# Altium schematic sheet big sheet.SchDoc: <Enter Sheet Title> (part 1 of 2) (continued)
## Nets
1V8_FTDI: C76.1 C117.1 C134.1 C135.1 U5.12(VCORE) U5.37(VCORE) U5.49(VREGOUT) U5.64(VCORE)
3V3_FTDI: C21.1 C22.1 C23.1 C24.1 C25.1 C26.1 C27.1 C28.1 C29.1 C30.1 C34.1 C35.1 C54.1 C55.1 C56.1 C64.2 C65.1 C69.1 C72.1 C75.1 C79.1 C80.1 C82.1 C83.1 C86.1 C87.1 C88.1 C89.1 C90.1 C91.1 C100.1 C110.1 C111.1 C112.1 C113.1 C114.1 C115.1 C121.1 C122.1 C125.1 C129.1 C136.1 C137.1 C138.1 C141.1 J1.2 J3.9(GREEN_A) J3.12(YELLOW_ANODE) J4.1(Vcc) J5.1 J7.2 L1.2 L3.1 L5.1 L6.1 L7.1 L9.1 LCD1.4(LEDA) LCD1.10(VCC) LCD1.11(VCC) P2.5 P2.7 P3.1 P3.17 P6.7 P9.1 P10.2 P11.2 PMOD0.6(VCC) PMOD0.12(VCC) PMOD1.6(VCC) PMOD1.12(VCC) R5.1 R6.1 R7.1 R20.1 R21.2 R45.1 R46.1 R54.1 R62.1 R64.1 R67.2 R71.2 R118.1 R119.1 R120.1 R121.1 R125.1 R126.1 R127.1 R128.1 R134.1 R160.2 R161.2 R162.2 R163.2 R164.2 R165.2 R166.2 R193.1 R199.1 R200.2 R201.2 R202.2 R203.1 R206.2 R207.2 R208.1 R209.1 R212.2 SD1.4(VDD) SJ1.1 SJ2.1 U3.8(VCC) U4.A17(VCCO_15) U4.B10(VCCO_16) U4.C13(VCCO_15) U4.D16(VCCO_15) U4.G15(VCCO_15) U4.H18(VCCO_15) U4.K4(VCCO_34) U4.K14(VCCO_15) U4.L17(VCCO_14) U4.N3(VCCO_34) U4.N13(VCCO_14) U4.P6(VCCO_34) U4.P8(CFGBVS_0) U4.P11(M2_0) U4.P12(M0_0) U4.P13(M1_0) U4.P16(VCCO_14) U4.R9(VCCO_0) U4.T2(VCCO_34) U4.T12(VCCO_14) U4.U5(VCCO_34) U4.U15(VCCO_14) U4.V8(VCCO_34) U4.V18(VCCO_14) U5.20(VCCIO) U5.31(VCCIO) U5.42(VCCIO) U5.50(VREGIN) U5.56(VCCIO) U7.15(VCC) U9.3(Vin) U11.1(IOVDD_1) U11.10(IOVDD_2) U11.22(IOVDD_3) U11.33(IOVDD_4) U11.42(IOVDD_5) U11.43(ADC_AVDD) U11.44(VREG_VIN) U11.48(USB_VDD) U11.49(IOVDD_6) U13.15(VREG_33) U13.16(VCC_5) U16.6(ORG) U16.8(VCC) U17.8(VCC) U18.8(VCC) U19.8(VCC) U22.5(VDD) U23.5(VDD) Y2.1(~{STBY}) Y2.4(VDD)  [also labelled VCCIO]
+1V85_XADC_VCC: C58.1 C59.1 C139.1 R37.1 U4.H10(VCCADC_0) U14.1(IN) U15.5(VOUT)
GND: C1.2 C2.2 C3.2 C5.2 C6.2 C7.2 C8.2 C9.2 C10.2 C11.2 C12.2 C13.2 C14.2 C15.2 C16.2 C17.2 C18.2 C19.2 C20.2 C21.2 C22.2 C23.2 C24.2 C25.2 C26.2 C27.2 C28.2 C29.2 C30.2 C31.2 C32.2 C33.2 C34.2 C35.2 C36.2 C37.2 C38.2 C39.2 C40.2 C41.2 C42.2 C43.2 C44.2 C45.2 C46.2 C47.2 C48.2 C50.2 C51.2 C52.2 C53.2 C54.2 C55.2 C56.2 C57.2 C58.2 C59.2 C62.2 C63.1 C64.1 C65.2 C66.2 C67.2 C68.2 C69.2 C70.2 C71.2 C72.2 C73.2 C74.2 C75.2 C76.2 C77.2 C78.2 C79.2 C80.2 C81.2 C82.2 C83.2 C84.2 C85.2 C86.2 C87.2 C88.2 C89.2 C90.2 C91.2 C92.2 C93.2 C94.2 C95.2 C96.2 C97.2 C99.2 C100.2 C101.2 C102.2 C108.2 C109.2 C110.2 C111.2 C112.2 C113.2 C114.2 C115.2 C116.2 C117.2 C118.2 C119.1 C120.2 C121.2 C122.2 C123.2 C124.2 C125.2 C126.2 C127.2 C128.2 C129.2 C130.2 C131.2 C132.2 C133.2 C134.2 C135.2 C136.2 C137.2 C138.2 C139.2 C141.2 C142.1 D3.K D4.K D5.K D6.K D7.K D8.K D9.K D10.K D11.K D12.K D13.K D14.K D15.K D16.K D17.K D18.K D19.K D20.K D22.K D23.K D24.K D25.K E1.A2 E2.A1 E3.A1 IC1.B3(VSS) IC1.C1(VSSQ_1) IC1.E5(VSSQ_2) J1.1 J2.A1-B12(GND) J2.B1-A12(GND) J3.8(CHS_GROUND) J4.3(GND) J4.5(GND) J4.9(GNDD) J5.4 J5.6 J5.8 J5.10 J5.12 J5.14 J5.16 J5.18 J5.20 J6.A1-B12(GND) J6.B1-A12(GND) J7.1 LCD1.2(GND) LCD1.5(GND) LCD1.13(GND) LED1.5(GND) LED2.5(GND) P2.2 P2.3 P3.6 P3.9 P3.14 P3.20 P3.25 P3.30 P3.34 P3.39 P4.7 P6.8 P7.8 P9.4 P10.6 P11.6 PMOD0.5(GND) PMOD0.11(GND) PMOD1.5(GND) PMOD1.11(GND) Q2.2(S) Q3.2(S) Q4.1(G) Q5.1(G) R1.2 R3.2 R4.2 R8.2 R11.2 R13.2 R14.2 R16.2 R17.1 R24.2 R25.2 R28.2 R33.2 R35.1 R36.1 R38.2 R39.2 R43.2 R76.1 R80.2 R81.1 R87.1 R88.2 R90.1 R94.1 R95.2 R96.1 R101.1 R102.2 R103.1 R108.1 R109.2 R110.1 R115.1 R116.2 R117.1 R129.2 R133.2 R135.2 R167.1 R195.1 R205.2 R213.1 SD1.6(VSS) SD1.10(SB) SD1.11(SHLD) SD1.12(SHLD) SD1.13(SHLD) SD1.14(SHLD) SW3.3(C) SW3.5(MNT_1) SW3.6(MNT_2) SW3.7(MNT_3) SW3.8(MNT_4) SW4.1 SW4.2 SW4.3 SW4.4 SW4.5 SW4.6 SW4.7 SW4.8 SW5.1(IN) SW6.7 SW6.8 SW7.3(C) SW7.5(MNT_1) SW7.6(MNT_2) SW7.7(MNT_3) SW7.8(MNT_4) SW8.5 SW8.MP1 SW8.MP2 SW8.MP3 SW8.MP4 SW9.3 SW9.4 SW9.5(Ground) U1.1(GND) U2.1(GND) U3.5(GND) U4.A2(GND) U4.A12(GND) U4.B5(GND) U4.B15(GND) U4.C8(GND) U4.C18(GND) U4.D1(GND) U4.D11(GND) U4.E4(GND) U4.E14(GND) U4.F7(GND) U4.F9(GND) U4.F11(GND) U4.F17(GND) U4.G8(GND) U4.G10(GND) U4.G12(GND) U4.H3(GND) U4.H7(GND) U4.H9(GNDADC_0) U4.H11(GND) U4.H13(GND) U4.J6(GND) U4.J8(GND) U4.J12(GND) U4.J16(GND) U4.K7(GND) U4.K11(GND) U4.L2(GND) U4.L8(GND) U4.L12(GND) U4.M5(GND) U4.M7(GND) U4.M9(GND) U4.M11(GND) U4.M15(GND) U4.N8(GND) U4.N10(GND) U4.N12(GND) U4.N18(GND) U4.P1(GND) U4.R4(GND) U4.R14(GND) U4.T7(GND) U4.T17(GND) U4.U10(GND) U4.V3(GND) U4.V13(GND) U5.1(GND) U5.5(GND) U5.10(AGND) U5.11(GND) U5.13(TEST) U5.15(GND) U5.25(GND) U5.35(GND) U5.47(GND) U5.51(GND) U5.65(GND) U6.4(DGND) U6.8(AGND) U6.13(AGND) U6.18(AGND) U6.22(DGND) U6.24(DGND) U6.29(DGND) U6.33(Paddle_Ground) U7.14(GND) U8.1(PGND) U8.2(PGND) U8.3(PGND) U8.5(GND) U8.17(PGND) U9.1(GND) U10.1(PGND) U10.2(PGND) U10.3(PGND) U10.5(GND) U10.17(PGND) U11.19(TESTEN) U11.57(GND) U12.25(VSS) U13.8(GND) U14.3(GND) U15.2(GND) U16.5(GND) U16.7(NC) U17.4(VSS) U17.9(EP) U18.4(VSS) U18.9(EP) U19.4(VSS) U19.9(EP) U20.11(VSS) U21.9(VINC-) U21.11(VSS) U21.13(VIND-) U22.2(GND) U23.2(GND) X1.2(GND) X1.4(GND) X2.2(GND) X2.4(GND) Y1.2 Y1.4 Y2.2(GND/Case) Y3.2 Y3.4  [also labelled XADC_AGND]
VCC1V8: C14.1 C15.1 C16.1 C17.1 C18.1 C19.1 C20.1 C31.1 C32.1 C53.1 C66.1 C67.1 C68.1 C123.1 C127.1 C131.1 C132.1 C133.1 IC1.B4(VCC) IC1.D1(VCCQ_1) IC1.E4(VCCQ_2) L8.1 R30.2 R32.2 R211.1 U4.A7(VCCO_35) U4.C3(VCCO_35) U4.D6(VCCO_35) U4.E8(VCCBATT_0) U4.F2(VCCO_35) U4.F12(VCCAUX) U4.G5(VCCO_35) U4.H12(VCCAUX) U4.J1(VCCO_35) U4.K12(VCCAUX) U4.M12(VCCAUX) U6.5(VDD_CO1.8) U6.23(VDD_D1.8) U6.25(VDD_IO) U6.30(VDD_IO) U9.2(Vout) U9.4(P) U13.9(VCC(I/O))
VCC_1V8A: C124.1 C128.1 L8.2 U6.9(VDD_A1.8)
VCCINT: C6.1 C7.1 C8.1 C9.1 C10.1 C11.1 C12.1 C13.1 C37.1 C38.1 L2.2 R9.1 U4.F8(VCCINT) U4.F10(VCCBRAM) U4.G7(VCCINT) U4.G9(VCCINT) U4.G11(VCCBRAM) U4.H8(VCCINT) U4.J7(VCCINT) U4.J11(VCCINT) U4.K8(VCCINT) U4.L7(VCCINT) U4.L11(VCCINT) U4.M8(VCCINT) U4.M10(VCCINT) U4.N7(VCCINT) U4.N9(VCCINT) U4.N11(VCCINT)
VCCOPAMP: C97.1 C99.1 C101.1 C102.1 R82.2 U20.4(VDD) U21.4(VDD) U21.10(VINC+) U21.12(VIND+)
VCCUSB3V3: C40.1 C41.1 C42.1 C43.1 C44.1 C45.1 C46.1 R15.1 R18.1 R72.2 R203.2 U2.2(Vout) U2.4(P) U12.1(VDD33) U12.9(VDD33) U12.18(VDD33)
232_RX: U4.N6(IO_L18N_T2_34) U7.9(ROUT)
232_TX: U4.P3(IO_L14N_T2_SRCC_34) U7.11(DIN)
485_DE: U3.3(DE) U4.M4(IO_L16P_T2_34)
485_DI: U3.4(DI) U4.M6(IO_L18P_T2_34)
485_REn: U3.2(~{RE}) U4.N4(IO_L16N_T2_34)
485_RO: U3.1(RO) U4.R2(IO_L15N_T2_DQS_34)
AH_AN0: P5.6 P6.1 R75.1 R77.1
AH_AN1: P5.5 R83.1 R84.1
AH_AN2: P5.4 R89.1 R91.1
AH_AN3: P5.3 R97.1 R98.1
AH_AN4: P5.2 R104.1 R105.1
AH_AN5: P5.1 R111.1 R112.1
AH_TMPIO0: P1.1 R188.1B
AH_TMPIO1: P1.2 R188.2B
AH_TMPIO2: P1.3 R188.3B
AH_TMPIO3: P1.4 R188.4B
AH_TMPIO4: P1.5 R189.1B
AH_TMPIO5: P1.6 R189.2B
AH_TMPIO6: P1.7 R189.3B
AH_TMPIO7: P1.8 R189.4B
AH_TMPIO8: P4.1 R190.1B
AH_TMPIO9: P4.2 R190.2B
AH_TMPIO10: P4.3 R190.3B
AH_TMPIO11: P4.4 R190.4B
AH_TMPIO12: P4.5 R191.1B
AH_TMPIO13: P4.6 R191.2B
AH_TMPIO14: P11.1 R191.3B
AH_TMPIO15: P11.3 R191.4B
AH_TMPIO16: P11.5 R168.2
AH_TMPIO17: P11.4 R169.2
ANALOG0_DIGITAL: R77.2 U4.G13(IO_0_15) U22.4(IO3)
ANALOG0_N: C98.2 R81.2 U4.C5(IO_L1N_T0_AD4N_35)
ANALOG0_P: C98.1 R79.2 U4.C6(IO_L1P_T0_AD4P_35)
ANALOG1_DIGITAL: R83.2 U4.D14(IO_L1P_T0_AD0P_15) U22.6(IO4)
ANALOG1_N: C103.2 R90.2 U4.B6(IO_L2N_T0_AD12N_35)
ANALOG1_P: C103.1 R86.2 U4.B7(IO_L2P_T0_AD12P_35)
ANALOG2_DIGITAL: R89.2 U4.C14(IO_L1N_T0_AD0N_15) U22.3(IO2)
ANALOG2_N: C104.2 R96.2 U4.A5(IO_L3N_T0_DQS_AD5N_35)
ANALOG2_P: C104.1 R93.2 U4.A6(IO_L3P_T0_DQS_AD5P_35)
ANALOG3_DIGITAL: R97.2 U4.C9(IO_L11P_T1_SRCC_16) U22.1(IO1)
ANALOG3_N: C105.2 R103.2 U4.E5(IO_L5N_T0_AD13N_35)
ANALOG3_P: C105.1 R100.2 U4.E6(IO_L5P_T0_AD13P_35)
ANALOG4_DIGITAL: R104.2 U4.B9(IO_L11N_T1_SRCC_16) U23.4(IO3)
ANALOG4_N: C106.2 R110.2 U4.B4(IO_L7N_T1_AD6N_35)
ANALOG4_P: C106.1 R107.2 U4.C4(IO_L7P_T1_AD6P_35)
ANALOG5_DIGITAL: R111.2 U4.B8(IO_L12P_T1_MRCC_16) U23.6(IO4)
ANALOG5_N: C107.2 R117.2 U4.A3(IO_L8N_T1_AD14N_35)
ANALOG5_P: C107.1 R114.2 U4.A4(IO_L8P_T1_AD14P_35)
APPSPI_CLK: R52.2 U4.A8(IO_L12N_T1_MRCC_16)
APPSPI_CS: R50.2 U4.D10(IO_L19N_T3_VREF_16)
APPSPI_D0: R47.1 U4.C11(IO_L13P_T2_MRCC_16)
APPSPI_D1: R48.1 U4.C10(IO_L13N_T2_MRCC_16)
APPSPI_D2: R49.1 U4.A10(IO_L14P_T2_SRCC_16)
APPSPI_D3: R51.1 U4.A9(IO_L14N_T2_SRCC_16)
CHA_TCK: SW1.3 U5.16(ADBUS0)
CHA_TDI: SW1.1 U5.17(ADBUS1)
CHA_TDO: SW1.2 U5.18(ADBUS2)
CHA_TMS: SW1.4 U5.19(ADBUS3)
CHB_GPIOL2: SW2.7 U5.33(BDBUS6)
CHB_GPIOL3: SW2.8 U5.34(BDBUS7)
CHB_nRST: SW2.5 U5.30(BDBUS4)
CHB_nSRST: SW2.6 U5.32(BDBUS5)
CHB_TCK: SW2.1 U5.26(BDBUS0)
CHB_TDI: SW2.2 U5.27(BDBUS1)
CHB_TDO: SW2.3 U5.28(BDBUS2)
CHB_TMS: SW2.4 U5.29(BDBUS3)
CHC_RXD: P12.3 U5.39(CDBUS1)
CHC_TXD: P12.1 U5.38(CDBUS0)
CHD_RXD: P12.7 U5.52(DDBUS1)
CHD_TXD: P12.5 U5.48(DDBUS0)
CHERIERR0: R139.1 SW2.10 U4.K6(IO_0_34)
CHERIERR1: R141.1 SW2.9 U4.L1(IO_L1P_T0_34)
CHERIERR2: R143.1 U4.M1(IO_L1N_T0_34)
CHERIERR3: R145.1 U4.K3(IO_L2P_T0_34)
CHERIERR4: R146.1 U4.L3(IO_L2N_T0_34)
CHERIERR5: R148.1 U4.N2(IO_L3P_T0_DQS_34)
CHERIERR6: R150.1 U4.N1(IO_L3N_T0_DQS_34)
CHERIERR7: R152.1 U4.M3(IO_L4P_T0_34)
CHERIERR8: R154.1 U4.M2(IO_L4N_T0_34)
ETHAVCC: C120.1 C126.1 C130.1 J3.4(CT) J3.5(CT) L9.2 U6.16(VDD_A3.3)
ETHCLK: R123.2 R124.1
ETHMAC_CIPO: U4.D4(IO_L11N_T1_SRCC_35) U6.27(SO)
ETHMAC_COPI: U4.D5(IO_L11P_T1_SRCC_35) U6.31(SI)
ETHMAC_CS: U4.H5(IO_L24N_T3_35) U6.26(CSN)
ETHMAC_INTR: R211.2 U4.H6(IO_L24P_T3_35) U6.3(~{INTR})
ETHMAC_LED0: R136.1 U6.1(LED0)
ETHMAC_LED1: R137.1 U6.32(LED1)
ETHMAC_RST: U4.J5(IO_25_35) U6.19(~{RST})
ETHMAC_RX_N: J3.6(RD-) R204.2 U6.12(RXM)
ETHMAC_RX_P: J3.3(RD+) R198.2 U6.11(RXP)
ETHMAC_SCLK: U4.E3(IO_L12P_T1_MRCC_35) U6.28(SCLK)
ETHMAC_TX_N: J3.2(TD-) R197.2 U6.15(TXM)
ETHMAC_TX_P: J3.1(TD+) R196.2 U6.14(TXP)
FPGA_CCLK: R65.1 U4.E9(CCLK_0)
FPGA_DONE: R134.2 U4.P10(DONE_0) U11.9(GPIO7)
FPGA_INITB: R5.2 U4.P7(INIT_B_0) U11.11(GPIO8)
FPGA_PGMB: R6.2 U4.P9(PROGRAM_B_0) U11.12(GPIO9)
FPGA_TCK: P10.3 R119.2 SW1.6 U4.E10(TCK_0)
FPGA_TDI: P10.1 R118.2 SW1.8 U4.E11(TDI_0)
FPGA_TDO: P10.4 R120.2 SW1.7 U4.E13(TDO_0)
FPGA_TMS: P10.5 R121.2 SW1.5 U4.E12(TMS_0)
FPGAIO_TURBO: SW6.2 U4.T4(IO_L12N_T1_MRCC_34)
FTDI_N: U5.7(DM) U12.2(USBDM_DN1/PRT_DIS_M1)
FTDI_NRST: R42.2 R73.2
FTDI_P: U5.8(DP) U12.3(USBDP_DN1/PRT_DIS_P1)
HYPERRAM_CK_N: IC1.B1(CK#) U4.G2(IO_L15N_T2_DQS_35)
HYPERRAM_CK_P: IC1.B2(CK) U4.H2(IO_L15P_T2_DQS_35)
HYPERRAM_CS: IC1.A3(CS#) U4.J2(IO_L22N_T3_35)
HYPERRAM_DQ0: IC1.D3(DQ0) U4.B1(IO_L9P_T1_DQS_AD7P_35)
HYPERRAM_DQ1: IC1.D2(DQ1) U4.E2(IO_L14P_T2_SRCC_35)
HYPERRAM_DQ2: IC1.C4(DQ2) U4.H1(IO_L17P_T2_35)
HYPERRAM_DQ3: IC1.D4(DQ3) U4.A1(IO_L9N_T1_DQS_AD7N_35)
HYPERRAM_DQ4: IC1.D5(DQ4) U4.E1(IO_L18N_T2_35)
HYPERRAM_DQ5: IC1.E3(DQ5) U4.B2(IO_L10N_T1_AD15N_35)
HYPERRAM_DQ6: IC1.E2(DQ6) U4.C1(IO_L16N_T2_35)
HYPERRAM_DQ7: IC1.E1(DQ7) U4.D2(IO_L14N_T2_SRCC_35)
HYPERRAM_nRST: IC1.A4(RESET#) U4.C2(IO_L16P_T2_35)
HYPERRAM_RWDS: IC1.C3(RWDS) U4.F1(IO_L18P_T2_35)
LCD_BACKLIGHT: Q2.1(G) R133.1 U4.N5(IO_L13P_T2_MRCC_34)
LCD_CLK: LCD1.9(SCL) U4.R5(IO_L19N_T3_VREF_34)
LCD_COPI: LCD1.8(SDA) U4.R3(IO_L11P_T1_SRCC_34)
LCD_CS: LCD1.12(CS) U4.P5(IO_L13N_T2_MRCC_34)
LCD_DC: LCD1.7(RS) U4.U4(IO_L8P_T1_34)
LCD_RST: LCD1.6(RESET) U4.R6(IO_L19P_T3_34)
LED_BOOTOK: R158.1 U4.L5(IO_L6N_T0_VREF_34)
LED_CHERI: R155.1 U4.L4(IO_L5N_T0_34)
LED_HALTED: R159.1 U4.L6(IO_L6P_T0_34)
LED_LEGACY: R157.1 U4.K5(IO_L5P_T0_34)
MAINCLK: R122.2 U4.P15(IO_L13P_T2_MRCC_14)
MB0: P6.2 R178.1B
MB1: P6.3 R178.2B
MB2: P6.4 R178.3B
MB3: P6.5 R178.4B
MB4: P6.6 R180.1B
MB5: P7.6 R180.2B R209.2
MB6: P7.5 R180.3B R208.2
MB7: P7.4 R180.4B
MB8: P7.3 R184.1B
MB9: P7.2 R184.2B
MB10: P7.1 R184.3B
MICROSD_CLK: R162.1 SD1.5(CLK) U4.U6(IO_L22N_T3_34)
MICROSD_CMD: R163.1 SD1.3(CMD) U4.R8(IO_L24P_T3_34)
MICROSD_DAT0: R161.1 SD1.7(DAT0) U4.V4(IO_L10N_T1_34)
MICROSD_DAT1: R160.1 SD1.8(DAT1) U4.R7(IO_L23P_T3_34)
MICROSD_DAT2: R165.1 SD1.1(DAT2) U4.V5(IO_L10P_T1_34)
MICROSD_DAT3: R164.1 SD1.2(CD/DAT3) U4.T8(IO_L24N_T3_34)
MICROSD_DET: R166.1 SD1.9(SA) U4.B3(IO_L10P_T1_AD15P_35)
NAVSW_0: SW8.1 U4.F5(IO_0_35)
NAVSW_1: SW8.4 U4.D8(IO_L4P_T0_35)
NAVSW_2: SW8.2 U4.C7(IO_L4N_T0_35)
NAVSW_3: SW8.3 U4.E7(IO_L6P_T0_35)
NAVSW_4: SW8.6 U4.D7(IO_L6N_T0_VREF_35)
NRST: J4.10(RST) J5.15 P2.6 R20.2 SW2.12 SW5.2(IN) U4.T5(IO_L12P_T1_MRCC_34) U11.28(GPIO17)
PMOD0_1: PMOD0.1(IO1) R174.1B
PMOD0_2: PMOD0.2(IO2) R174.2B
PMOD0_3: PMOD0.3(IO3) R174.3B
PMOD0_4: PMOD0.4(IO4) R174.4B
PMOD0_5: PMOD0.7(IO5) R176.1B
PMOD0_6: PMOD0.8(IO6) R176.2B
PMOD0_7: PMOD0.9(IO7) R176.3B
PMOD0_8: PMOD0.10(IO8) R176.4B
PMOD1_1: PMOD1.1(IO1) R172.1B
PMOD1_2: PMOD1.2(IO2) R172.2B
PMOD1_3: PMOD1.3(IO3) R172.3B
PMOD1_4: PMOD1.4(IO4) R172.4B
PMOD1_5: PMOD1.7(IO5) R173.1B
PMOD1_6: PMOD1.8(IO6) R173.2B
PMOD1_7: PMOD1.9(IO7) R173.3B
PMOD1_8: PMOD1.10(IO8) R173.4B
PMODC_1: P8.1 R194.4B
PMODC_2: P8.2 R186.2
PMODC_3: P8.3 R187.2
PMODC_4: P8.4 R194.1B
PMODC_5: P8.5 R194.2B
PMODC_6: P8.6 R194.3B
PWRIN_5V: C2.1 C3.1 C5.1 C33.1 C36.1 C39.1 P2.1 P3.2 P3.4 P7.7 Q4.2(S) Q5.2(S) R19.2 R41.2 SJ1.3 U2.3(Vin) U8.9(VDD) U8.10(PVDD) U8.11(PVDD) U8.12(PVDD) U10.9(VDD) U10.10(PVDD) U10.11(PVDD) U10.12(PVDD)
QSPI_CS: R50.1 R57.1 U17.1(~{S})
QSPI_D0: R47.2 R60.1 U17.5(DQ0)
QSPI_D1: R48.2 R55.1 U17.2(DQ1)
QSPI_D2: R46.2 R49.2 R61.1 U17.3(~{W}/DQ2)
QSPI_D3: R45.2 R51.2 R63.1 U17.7(DQ3/~{HOLD})
QSPI_SCLK: R52.1 R59.1 U17.6(C)
RGBLED0: Q3.1(G) R193.2 R205.1 R210.1 U4.D9(IO_L6N_T0_VREF_16)
RP2040_CLK: R70.1 U4.T14(IO_L14P_T2_SRCC_14)
RP2040_LED0: D26.K U11.38(GPIO26/ADC0)
RP2040_LED1: D27.K U11.37(GPIO25)
RP2040_LED2: D28.K U11.36(GPIO24)
RP2040_LED3: R156.1 U11.29(GPIO18)
RP2040_N: R58.1 U12.4(USBDM_DN2/PRT_DIS_M2)
RP2040_NRST: R71.1 R74.2 U11.26(RUN)
RP2040_P: R56.1 U12.5(USBDP_DN2/PRT_DIS_P2)
RP2040_PREQ: R171.2 U11.8(GPIO6)
RP2040_RGBLED0: R210.2 U11.18(GPIO15)
RP2040_RX: R68.1 U4.M17(IO_L10N_T1_D15_14)
RP2040_SPARE: R69.1 U4.P4(IO_L14P_T2_SRCC_34)
RP2040_SW0: SW3.1 U11.41(GPIO29/ADC3)
RP2040_SW1: SW3.2 U11.40(GPIO28/ADC2)
RP2040_SW2: SW3.4 U11.39(GPIO27/ADC1)
RP2040_TX: R66.1 U4.K18(IO_L1N_T0_D01_DIN_14)
RP_N: R58.2 U11.46(USB_DM)
RP_P: R56.2 U11.47(USB_DP)
RPH_G0: P3.27 R179.4B
RPH_G1: P3.28 R183.4B
RPH_G2_SDA: P3.3 R175.3B R206.1
RPH_G3_SCL: P3.5 R175.4B R207.1
RPH_G4: P3.7 R177.1B
RPH_G5: P3.29 R181.1B
RPH_G6: P3.31 R181.2B
RPH_G7_SPI0_CE1: P3.26 R183.3B
RPH_G8_SPI0_CE0: P3.24 R183.2B
RPH_G9_SPI0_CIPO: P3.21 R179.2B
RPH_G10_SPI0_COPI: P3.19 R179.1B
RPH_G11_SPI0_SCLK: P3.23 R179.3B
RPH_G12: P3.32 R185.1B
RPH_G13: P3.33 R181.3B
RPH_G16_CE2: P3.36 R185.2B
RPH_G17_SPI1_CE1: P3.11 R177.2B
RPH_G18_SPI1_CE0: P3.12 R182.2B
RPH_G19_SPI1_CIPO: P3.35 R181.4B
RPH_G20_SPI1_COPI: P3.38 R185.3B
RPH_G21_SPI1_SCLK: P3.40 R185.4B
RPH_G22: P3.15 R177.4B
RPH_G23: P3.16 R182.3B
RPH_G24: P3.18 R182.4B
RPH_G25: P3.22 R183.1B R212.1 R213.2
RPH_G26: P3.37 R182.1B
RPH_G27: P3.13 R177.3B
RPH_RXD0: P3.10 R175.1B
RPH_TXD0: P3.8 R175.2B
SCL0: J1.4 P4.10 R126.2 R170.2B
SCL1: J7.4 R128.2 R170.4B
SDA0: J1.3 P4.9 R125.2 R170.1B
SDA1: J7.3 R127.2 R170.3B
SELSW0: SW7.1 U4.D3(IO_L12N_T1_MRCC_35)
SELSW1: SW7.2 U4.F4(IO_L13P_T2_MRCC_35)
SELSW2: SW7.4 U4.F3(IO_L13N_T2_MRCC_35)
SER0_RX: P12.2 U4.D18(IO_L21N_T3_DQS_A18_15)
SER0_TX: P12.4 U4.C17(IO_L20N_T3_A19_15)
SER1_RX: P12.6 U4.G18(IO_L22P_T3_A17_15)
SER1_TX: P12.8 U4.E18(IO_L21P_T3_DQS_15)
USB_N: J2.A7(Dn1) J2.B7(Dn2) U1.2(IO1) U12.19(USBDM_UP)
USB_nSUSPEND: R14.1 SW6.6 U12.17(SUSP_IND/LOCAL_PWR/(NON_REM0))
USB_P: J2.A6(Dp1) J2.B6(Dp2) U1.3(IO2) U12.20(USBDP_UP)
USB_VBUS: C1.1 J2.A4-B9(VBUS) J2.B4-A9(VBUS) Q1.2(S) R2.1 R12.2 R13.1 U1.4(VCC)
USBC_3_D_N: J6.A7(Dn1) J6.B7(Dn2) R29.1 R34.1 R35.2
USBC_3_D_P: J6.A6(Dp1) J6.B6(Dp2) R27.1 R31.1 R36.2
USBC_F_D_N: R29.2 U13.11(D-)
USBC_F_D_P: R27.2 U13.12(D+)
USR_JTAG_TCK: J4.4(TCK) J5.9 J5.11 SW2.16 U4.E15(IO_L11P_T1_SRCC_15)
USR_JTAG_TDI: J4.8(TDI) J5.5 SW2.15 U4.G17(IO_L18N_T2_A23_15)
USR_JTAG_TDO: J4.6(TDO) J5.13 SW2.14 U4.J14(IO_L19P_T3_A22_15)
USR_JTAG_TMS: J4.2(TMS) J5.7 SW2.13 U4.H15(IO_L19N_T3_A21_VREF_15)
USR_JTAG_TRST: J5.3 SW2.11 U4.C16(IO_L20P_T3_A20_15)
USRLED0: R138.1 U4.B13(IO_L2P_T0_AD8P_15)
USRLED1: R140.1 U4.B14(IO_L2N_T0_AD8N_15)
USRLED2: R142.1 U4.C12(IO_L3P_T0_DQS_AD1P_15)
USRLED3: R144.1 U4.B12(IO_L3N_T0_DQS_AD1N_15)
USRLED4: R147.1 U4.B11(IO_L4P_T0_15)
USRLED5: R149.1 U4.A11(IO_L4N_T0_15)
USRLED6: R151.1 U4.F13(IO_L5P_T0_AD9P_15)
USRLED7: R153.1 U4.F14(IO_L5N_T0_AD9N_15)
USRSW0: SW4.16 U4.D12(IO_L6P_T0_15)
USRSW1: SW4.15 U4.D13(IO_L6N_T0_VREF_15)
USRSW2: SW4.14 U4.B16(IO_L7P_T1_AD2P_15)
USRSW3: SW4.13 U4.B17(IO_L7N_T1_AD2N_15)
USRSW4: SW4.12 U4.A15(IO_L8P_T1_AD10P_15)
USRSW5: SW4.11 U4.A16(IO_L8N_T1_AD10N_15)
USRSW6: SW4.10 U4.A13(IO_L9P_T1_DQS_AD3P_15)
USRSW7: SW4.9 U4.A14(IO_L9N_T1_DQS_AD3N_15)
USRUSB_OE: R30.1 U4.J3(IO_L22P_T3_35) U13.3(~{OE})
USRUSB_RCV: U4.J4(IO_L21P_T3_DQS_35) U13.4(RCV)
USRUSB_SOFTCN: U4.H4(IO_L21N_T3_DQS_35) U13.2(SOFTCON)
USRUSB_SPD: U4.G1(IO_L17N_T2_35) U13.10(SPEED)
USRUSB_SUS: R32.1 U4.K2(IO_L23P_T3_35) U13.7(SUSPND)
USRUSB_V_N: U4.F6(IO_L19N_T3_VREF_35) U13.6(VM)
USRUSB_V_P: U4.G6(IO_L19P_T3_35) U13.5(VP)
USRUSB_VBUSDETECT: R23.2 R25.1 U4.K1(IO_L23N_T3_35)
USRUSB_VMO: U4.G3(IO_L20N_T3_35) U13.14(VMO)
USRUSB_VPO: U4.G4(IO_L20P_T3_35) U13.13(VPO)
XADC_VREF_N: C60.2 C140.2 R195.2 U4.J9(VREFN_0)
XADC_VREF_P: C60.1 C140.1 U4.K10(VREFP_0) U14.2(OUT)
NetC4_1: C4.1 Q1.3(D) Q5.3(D)
NetC4_2: C4.2 Q1.1(G) R2.2 R3.1
NetC47_1: C47.1 U12.10(CRFILT)
NetC48_1: C48.1 U12.23(PLLFILT)
NetC49_1: C49.1 U7.5(C2+)
NetC49_2: C49.2 U7.6(C2-)
NetC50_1: C50.1 C51.1 J6.A4-B9(VBUS) J6.B4-A9(VBUS) R22.1 R23.1 R26.1 R41.1
NetC52_1: C52.1 J6.1(MNT_1) J6.2(MNT_2) J6.3(MNT_3) J6.4(MNT_4) R33.1
NetC57_1: C57.1 L3.2 U15.1(VIN) U15.3(ENA)
NetC61_1: C61.1 U7.4(C1-)
NetC61_2: C61.2 U7.2(C1+)
NetC62_1: C62.1 U7.7(V-)
NetC63_2: C63.2 U7.3(V+)
NetC70_1: C70.1 C71.1 L5.2 U5.9(VPLL)
NetC73_1: C73.1 C74.1 L6.2 U5.4(VPHY)
NetC77_1: C77.1 U5.2(OSCI) Y1.1
NetC78_1: C78.1 U5.3(OSCO) Y1.3
NetC81_1: C81.1 C84.1 C85.1 U11.23(DVDD_1) U11.45(VREG_VOUT) U11.50(DVDD_2)
NetC92_1: C92.1 U11.20(XIN) X2.1(IN)
NetC93_1: C93.1 U11.21(XOUT) X2.3(OUT)
NetC94_1: C94.1 R72.1 U12.15(~{RESET})
NetC95_1: C95.1 U12.22(XTALIN/CLKIN) X1.3(OUT)
NetC96_1: C96.1 U12.21(XTALOUT/(CLKIN_EN)) X1.1(IN)
NetC108_1: C108.1 R124.2 U6.20(X1) Y3.1
NetC109_1: C109.1 U6.21(X2) Y3.3
NetC116_1: C116.1 J2.1(MNT_1) J2.2(MNT_2) J2.3(MNT_3) J2.4(MNT_4) R129.1
NetC118_1: C118.1 J3.13(MNT_1) J3.14(MNT_2) R135.1
NetC119_2: C119.2 R198.1 R204.1
NetC142_2: C142.2 R196.1 R197.1
NetD3_A: D3.A R138.2
NetD4_A: D4.A R140.2
NetD5_A: D5.A R142.2
NetD6_A: D6.A R144.2
NetD7_A: D7.A R147.2
NetD8_A: D8.A R149.2
NetD9_A: D9.A R151.2
NetD10_A: D10.A R153.2
NetD11_A: D11.A R156.2
NetD12_A: D12.A R139.2
NetD13_A: D13.A R141.2
NetD14_A: D14.A R158.2
NetD15_A: D15.A R155.2
NetD16_A: D16.A R143.2
NetD17_A: D17.A R157.2
NetD18_A: D18.A R145.2
NetD19_A: D19.A R159.2
NetD20_A: D20.A R146.2
NetD22_A: D22.A R148.2
NetD23_A: D23.A R150.2
NetD24_A: D24.A R152.2
NetD25_A: D25.A R154.2
NetD26_A: D26.A R200.1
NetD27_A: D27.A R201.1
NetD28_A: D28.A R202.1
NetE1_A1: E1.A1 Q4.3(D)
NetE2_A2: E2.A2 U7.8(RIN)
NetE2_A3: E2.A3 U7.13(DOUT)
NetE3_A2: E3.A2 R40.2 U3.6(A/Y)
NetE3_A3: E3.A3 R40.1 U3.7(B/Z)
NetJ2_A5: J2.A5(CC1) R1.1
NetJ2_B5: J2.B5(CC2) R4.1
NetJ3_10: J3.10(GREEN_C) R136.2
NetJ3_11: J3.11(YELLOW_CATHODE) R137.2
NetJ5_2: J5.2 SJ2.2
NetJ6_A5: J6.A5(CC1) R22.2 R24.1
NetJ6_B5: J6.B5(CC2) R26.2 R28.1
NetL1_1: L1.1 U8.13(LX) U8.14(LX) U8.15(LX)
NetL2_1: L2.1 U10.13(LX) U10.14(LX) U10.15(LX)
NetL7_2: L7.2 R82.1
NetLCD1_3: LCD1.3(LEDK) R130.1 R131.1 R132.1
NetLED1_2: LED1.2(VCC) LED2.2(VCC) R19.1 R192.1
NetLED1_4: LED1.4(DI) LED2.3(DO)
NetLED1_6: LED1.6(BI) LED2.1(BO)
NetLED2_4: LED2.4(DI) LED2.6(BI) Q3.3(D) R192.2
NetP2_4: P2.4 SJ1.2
NetP9_2: P9.2 U11.25(SWDIO)
NetP9_3: P9.3 U11.24(SWCLK)
NetQ2_3: Q2.3(D) R130.2 R131.2 R132.2
NetR7_2: R7.2 R8.1 U8.4(FB)
NetR9_2: R9.2 R10.1 R11.1 U10.4(FB)
NetR10_2: R10.2 SW6.1
NetR12_1: R12.1 U12.16(VBUS_DET)
NetR15_2: R15.2 SW6.3 U8.7(EN) U10.7(EN)
NetR16_1: R16.1 U12.24(RBIAS)
NetR17_2: R17.2 U12.14(SMBCLK/CFG_SEL0)
NetR18_2: R18.2 U12.13(SMBDATA/NON_REM1)
NetR21_1: R21.1 U7.12(FORCEON) U7.16(~{FORCEOFF})
NetR31_2: R31.2 R34.2 U13.1(VPU_33)
NetR37_2: R37.2 R38.1 U15.4(ADJ)
NetR39_1: R39.1 U7.1(~{EN})
NetR42_1: R42.1 U5.14(RESET#)
NetR43_1: R43.1 U5.6(REF)
NetR44_1: R44.1 U5.61(EEDATA) U16.3(DI)
NetR44_2: R44.2 R199.2 U16.4(DO)
NetR53_1: R53.1 R54.2 U11.56(QSPI_SS_N) U18.1(~{S})
NetR53_2: R53.2 SW9.1 SW9.2
NetR55_2: R55.2 U11.2(GPIO0)
NetR57_2: R57.2 U11.3(GPIO1)
NetR59_2: R59.2 U11.4(GPIO2)
NetR60_2: R60.2 U11.5(GPIO3)
NetR61_2: R61.2 U11.6(GPIO4)
NetR62_2: R62.2 U19.7(DQ3/~{HOLD})
NetR63_2: R63.2 U11.7(GPIO5)
NetR64_2: R64.2 U19.3(~{W}/DQ2)
NetR65_2: R65.2 U11.13(GPIO10)
NetR66_2: R66.2 U11.14(GPIO11)
NetR67_1: R67.1 U11.32(GPIO21) U19.1(~{S})
NetR68_2: R68.2 U11.15(GPIO12)
NetR69_2: R69.2 U11.16(GPIO13)
NetR70_2: R70.2 U11.17(GPIO14)
NetR73_1: R73.1 U12.7(PRTPWR1/(BC_EN1))
NetR74_1: R74.1 U12.11(PRTPWR2)
NetR75_2: R75.2 R76.2 U20.3(VINA+)
NetR78_1: R78.1 U20.1(VOUTA) U20.2(VINA-)
NetR78_2: R78.2 R79.1 R80.1
NetR84_2: R84.2 R87.2 U20.5(VINB+)
NetR85_1: R85.1 U20.6(VINB-) U20.7(VOUTB)
NetR85_2: R85.2 R86.1 R88.1
NetR91_2: R91.2 R94.2 U20.10(VINC+)
NetR92_1: R92.1 U20.8(VOUTC) U20.9(VINC-)
NetR92_2: R92.2 R93.1 R95.1
NetR98_2: R98.2 R101.2 U20.12(VIND+)
NetR99_1: R99.1 U20.13(VIND-) U20.14(VOUTD)
NetR99_2: R99.2 R100.1 R102.1
NetR105_2: R105.2 R108.2 U21.3(VINA+)
NetR106_1: R106.1 U21.1(VOUTA) U21.2(VINA-)
NetR106_2: R106.2 R107.1 R109.1
NetR112_2: R112.2 R115.2 U21.5(VINB+)
NetR113_1: R113.1 U21.6(VINB-) U21.7(VOUTB)
NetR113_2: R113.2 R114.1 R116.1
NetR122_1: R122.1 R123.1 Y2.3(Output)
NetR167_2: R167.2 U6.17(ISET)
NetR168_1: R168.1 U4.N17(IO_L9P_T1_DQS_14)
NetR169_1: R169.1 U4.M13(IO_L6N_T0_D08_VREF_14)
NetR170_1A: R170.1A U4.U7(IO_L22P_T3_34)
NetR170_2A: R170.2A U4.V9(IO_L21N_T3_DQS_34)
NetR170_3A: R170.3A U4.V7(IO_L20P_T3_34)
NetR170_4A: R170.4A U4.U9(IO_L21P_T3_DQS_34)
NetR171_1: R171.1 U4.U3(IO_L8N_T1_34)
NetR172_1A: R172.1A U4.B18(IO_L10P_T1_AD11P_15)
NetR172_2A: R172.2A U4.E16(IO_L11N_T1_SRCC_15)
NetR172_3A: R172.3A U4.A18(IO_L10N_T1_AD11N_15)
NetR172_4A: R172.4A U4.H17(IO_L18P_T2_A24_15)
NetR173_1A: R173.1A U4.D15(IO_L12P_T1_MRCC_15)
NetR173_2A: R173.2A U4.C15(IO_L12N_T1_MRCC_15)
NetR173_3A: R173.3A U4.H16(IO_L13P_T2_MRCC_15)
NetR173_4A: R173.4A U4.G16(IO_L13N_T2_MRCC_15)
NetR174_1A: R174.1A U4.H14(IO_L15P_T2_DQS_15)
NetR174_2A: R174.2A U4.F16(IO_L14N_T2_SRCC_15)
NetR174_3A: R174.3A U4.F15(IO_L14P_T2_SRCC_15)
NetR174_4A: R174.4A U4.G14(IO_L15N_T2_DQS_ADV_B_15)
NetR175_1A: R175.1A U4.L18(IO_L4P_T0_D04_14)
NetR175_2A: R175.2A U4.K17(IO_L1P_T0_D00_MOSI_14)
NetR175_3A: R175.3A U4.L13(IO_L6P_T0_FCS_B_14)
NetR175_4A: R175.4A U4.M16(IO_L10P_T1_D14_14)
NetR176_1A: R176.1A U4.J13(IO_L17N_T2_A25_15)
NetR176_2A: R176.2A U4.E17(IO_L16P_T2_A28_15)
NetR176_3A: R176.3A U4.D17(IO_L16N_T2_A27_15)
NetR176_4A: R176.4A U4.K13(IO_L17P_T2_A26_15)
NetR177_1A: R177.1A U4.N15(IO_L11P_T1_SRCC_14)
NetR177_2A: R177.2A U4.M14(IO_L2N_T0_D03_14)
NetR177_3A: R177.3A U4.L14(IO_L2P_T0_D02_14)
NetR177_4A: R177.4A U4.L16(IO_L3N_T0_DQS_EMCCLK_14)
NetR178_1A: R178.1A U4.P2(IO_L15P_T2_DQS_34)
NetR178_2A: R178.2A U4.R1(IO_L17P_T2_34)
NetR178_3A: R178.3A U4.T1(IO_L17N_T2_34)
NetR178_4A: R178.4A U4.U1(IO_L7P_T1_34)
NetR179_1A: R179.1A U4.V16(IO_L16N_T2_A15_D31_14)
NetR179_2A: R179.2A U4.V17(IO_L18N_T2_A11_D27_14)
NetR179_3A: R179.3A U4.P17(IO_L12P_T1_MRCC_14)
NetR179_4A: R179.4A U4.U17(IO_L17P_T2_A14_D30_14)
NetR180_1A: R180.1A U4.T3(IO_L11N_T1_SRCC_34)
NetR180_2A: R180.2A U4.V1(IO_L7N_T1_34)
NetR180_3A: R180.3A U4.U2(IO_L9P_T1_DQS_34)
NetR180_4A: R180.4A U4.V2(IO_L9N_T1_DQS_34)
NetR181_1A: R181.1A U4.T13(IO_L23P_T3_A03_D19_14)
NetR181_2A: R181.2A U4.U14(IO_L22P_T3_A05_D21_14)
NetR181_3A: R181.3A U4.R13(IO_L5N_T0_D07_14)
NetR181_4A: R181.4A U4.V14(IO_L22N_T3_A04_D20_14)
NetR182_1A: R182.1A U4.R15(IO_L13N_T2_MRCC_14)
NetR182_2A: R182.2A U4.P18(IO_L9N_T1_DQS_D13_14)
NetR182_3A: R182.3A U4.N14(IO_L8P_T1_D11_14)
NetR182_4A: R182.4A U4.N16(IO_L11N_T1_SRCC_14)
NetR183_1A: R183.1A U4.L15(IO_L3P_T0_DQS_PUDC_B_14)
NetR183_2A: R183.2A U4.V15(IO_L16P_T2_CSI_B_14)
NetR183_3A: R183.3A U4.R11(IO_0_14)
NetR183_4A: R183.4A U4.T15(IO_L14N_T2_SRCC_14)
NetR184_1A: R184.1A U4.U8(IO_25_34)
NetR184_2A: R184.2A U4.T6(IO_L23N_T3_34)
NetR184_3A: R184.3A U4.V6(IO_L20N_T3_34)
NetR185_1A: R185.1A U4.V10(IO_L21P_T3_DQS_14)
NetR185_2A: R185.2A U4.T9(IO_L24P_T3_A01_D17_14)
NetR185_3A: R185.3A U4.T10(IO_L24N_T3_A00_D16_14)
NetR185_4A: R185.4A U4.V11(IO_L21N_T3_DQS_A06_D22_14)
NetR186_1: R186.1 U4.J15(IO_L24N_T3_RS0_15)
NetR187_1: R187.1 U4.K16(IO_25_15)
NetR188_1A: R188.1A U4.T11(IO_L19P_T3_A10_D26_14)
NetR188_2A: R188.2A U4.U12(IO_L20P_T3_A08_D24_14)
NetR188_3A: R188.3A U4.R12(IO_L5P_T0_D06_14)
NetR188_4A: R188.4A U4.U13(IO_L23N_T3_A02_D18_14)
NetR189_1A: R189.1A U4.R10(IO_25_14)
NetR189_2A: R189.2A U4.V12(IO_L20N_T3_A07_D23_14)
NetR189_3A: R189.3A U4.U11(IO_L19N_T3_A09_D25_VREF_14)
NetR189_4A: R189.4A U4.M18(IO_L4N_T0_D05_14)
NetR190_1A: R190.1A U4.U18(IO_L17N_T2_A13_D29_14)
NetR190_2A: R190.2A U4.T16(IO_L15N_T2_DQS_DOUT_CSO_B_14)
NetR190_3A: R190.3A U4.U16(IO_L18P_T2_A12_D28_14)
NetR190_4A: R190.4A U4.T18(IO_L7N_T1_D10_14)
NetR191_1A: R191.1A U4.R16(IO_L15P_T2_DQS_RDWR_B_14)
NetR191_2A: R191.2A U4.R17(IO_L12N_T1_MRCC_14)
NetR191_3A: R191.3A U4.R18(IO_L7P_T1_D09_14)
NetR191_4A: R191.4A U4.P14(IO_L8N_T1_D12_14)
NetR194_1A: R194.1A U4.J18(IO_L23N_T3_FWE_B_15)
NetR194_2A: R194.2A U4.F18(IO_L22N_T3_A16_15)
NetR194_3A: R194.3A U4.J17(IO_L23P_T3_FOE_B_15)
NetR194_4A: R194.4A U4.K15(IO_L24P_T3_RS1_15)
NetU5_62: U5.62(EECLK) U16.2(SK)
NetU5_63: U5.63(EECS) U16.1(CS)
NetU11_31: U11.31(GPIO20) U19.2(DQ1)
NetU11_34: U11.34(GPIO22) U19.6(C)
NetU11_35: U11.35(GPIO23) U19.5(DQ0)
NetU11_51: U11.51(QSPI_SD3) U18.7(DQ3/~{HOLD})
NetU11_52: U11.52(QSPI_SCLK) U18.6(C)
NetU11_53: U11.53(QSPI_SD0) U18.5(DQ0)
NetU11_54: U11.54(QSPI_SD2) U18.3(~{W}/DQ2)
NetU11_55: U11.55(QSPI_SD1) U18.2(DQ1)

Not connected (* = marked no-connect by the designer): IC1 A2(RFU_1)* A5(RFU_2)* B5(RFU_3)* C2(RFU_4)* C5(RFU_5)*; J2 A8(SBU1) B8(SBU2); J3 7(NC); J4 7(NC); J5 17(9) 19(9); J6 A8(SBU1) B8(SBU2); LCD1 1(NC) 14(NC); LED1 1(BO) 3(DO); MH1 1; MH2 1; MH3 1; MH4 1; MH5 1; MH6 1; MH7 1; P2 8*; P4 8*; R184 4A 4B; SW6 4 5; U4 J10(VP_0)* K9(VN_0)* L9(DXN_0)* L10(DXP_0)*; U5 21(ADBUS4) 22(ADBUS5) 23(ADBUS6) 24(ADBUS7) 36(SUSPEND#) 40(CDBUS2) 41(CDBUS3) 43(CDBUS4) 44(CDBUS5) 45(CDBUS6) 46(CDBUS7) 53(DDBUS2) 54(DDBUS3) 55(DDBUS4) 57(DDBUS5) 58(DDBUS6) 59(DDBUS7) 60(PWREN#); U6 2(PME)* 6(EDD_IO) 7(EESK) 10(EECS); U7 10(~{INVALID})*; U8 6(NC) 8(NC) 16(NC); U10 6(NC) 8(NC) 16(NC); U11 27(GPIO16) 30(GPIO19); U12 6(NC)* 8(~{OCS1})* 12(~{OCS2})*; U21 8(VOUTC) 14(VOUTD); U23 1(IO1) 3(IO2)

## Layout directives
net class Power: 3V3_FTDI, PWRIN_5V, USB_VBUS, VCC1V8, VCCINT, VCCUSB3V3
differential pair; differential pair class USB_DIFF_PAIR: FTDI_N, FTDI_P, RP2040_N, RP2040_P, RP_N, RP_P, USB_N, USB_P
differential pair; differential pair class ETHERNET: ETHMAC_RX_N, ETHMAC_RX_P, ETHMAC_TX_N, ETHMAC_TX_P
differential pair; differential pair class DIFF90: FTDI_N, FTDI_P, USBC_3_D_N, USBC_3_D_P, USBC_F_D_N, USBC_F_D_P, USRUSB_V_N, USRUSB_V_P
differential pair; differential pair class ANALOG: XADC_VREF_N, XADC_VREF_P
differential pair; Parameter 1: ANALOG_DIFF_PAIR: ANALOG0_N, ANALOG0_P, ANALOG1_N, ANALOG1_P, ANALOG2_N, ANALOG2_P, ANALOG3_N, ANALOG3_P, ANALOG4_N, ANALOG4_P, ANALOG5_N, ANALOG5_P
net class HYPER_200mil_Length: HYPERRAM_CK_N, HYPERRAM_CK_P, HYPERRAM_DQ0, HYPERRAM_DQ1, HYPERRAM_DQ2, HYPERRAM_DQ3, HYPERRAM_DQ4, HYPERRAM_DQ5, HYPERRAM_DQ6, HYPERRAM_DQ7, HYPERRAM_RWDS
differential pair; differential pair class HR_1: HYPERRAM_CK_N, HYPERRAM_CK_P
net class HYPER_1_Clks: HYPERRAM_CK_N, HYPERRAM_CK_P
net class HYPER_1_Length: HYPERRAM_DQ0, HYPERRAM_DQ1, HYPERRAM_DQ2, HYPERRAM_DQ3, HYPERRAM_DQ4, HYPERRAM_DQ5, HYPERRAM_DQ6, HYPERRAM_DQ7, HYPERRAM_RWDS

## Notes on the sheet
- Assumes +5V, only Neopixels use this directly, along with shields. If resistor is removed to isolate Neopixel, the input voltage range increases.
- Strap config, non-removable ports.
- (near R41) Used to allow basic host mode development, or to power device from this USB port. But default DNM as risk of damaging connected device!
- The PRTPWR pins could be used to reset attached devices. But that will interfer with standalon usage.
  Need to check if reset is required for USB to be picked up depending on power order (e.g. if board is self-powered, then someone plugs in USB). In theory attached devices should pick up the USB suspend signal but something to confirm works OK.
  If required the series resistors will enable that for now.
- Changes:
  -05:
  * Fix ethernet termination
  -06:
  * Add option for RGBLED pull direction
  * Add I2C pull-ups on R-Pi Header
  -07:
  * Add RGBLED0 driven by RP2040 option
  -08:
  * Minor PCB silkscreen changes, production version
  -09:
  * PUDC has pull-up resistor
  * Input protection is PMOS
  * Remove D1/D2
- Known Issues:
  * See issues on https://github.com/newaetech/sonata-pcb for tracking
  -08:
  *RGB leds are always powered on, which can have random or old data loaded.
- Confirm connected to 1.8V FPGA bank.
- (near R122) PCB: Place near Y2
- (near P1) D0
- (near P1) D1
- (near P1) D2
- (near P3) GPIO2/SDA1
- (near P3) GPIO3/SCL1
- (near P3) GPIO4
- (near P3) +3V3
- +5V
- (near P3) GND
- (near P3) TXD0
- (near P1) D3
- (near P1) D4
- (near P1) D5
- (near P1) D6
- (near P1) D7
- (near SJ1) Some shields use +5V as I/O power instead of VIO. By default board puts 3.3V on 5V. User must change jumper if shield needs 5V, but still gives 3.3V I/O voltage (some do).
- (near SW1) Isolate FTDI from JTAG port to use external JTAG cable for FPGA.
- Non-standard. Roughly based on AVR 6-pin ISP header.
- GND
- (near P3) GPIO17
- (near P3) GPIO27
- (near P3) GPIO22
- (near P3) RXD0
- (near P3) GPIO18
- (near P3) GPIO23
- (near P3) GPIO24
- (near P3) GPIO10/COPI
- (near P3) GPIO9/CIPO
- (near P3) GPIO11/SCLK
- (near P3) GPIO0/ID_SD
- (near P3) GPIO25
- (near P3) CE0/GPIO8
- (near P3) CE1/GPIO7
- (near P3) ID_SC/GPIO1
- (near P4) D8
- (near P4) D9
- (near P4) D10
- (near P4) D11
- (near P4) D12
- (near P5) A3
- (near P5) A4
- (near P5) A5
- (near P3) GPIO19/MISO
- (near P3) GPIO5
- (near P3) GPIO6
- (near P3) GPIO13
- (near P3) GPIO26
- (near P3) GPIO12
- (near P3) CE2/GPIO16
- (near P3) MOSI/GPIO20
- (near P4) D13
- (near P5) A0
- (near P5) A1
- (near P5) A2
- (near P3) SCLK/GPIO21
- Can use these as strapping pins if needed (default - LED outputs).
- (near PMOD1) 2x15 (SSW-115-02-G-D-RA) can be mounted instead of PMODs.
- (near SD1) 3.3V SD Card Only
- (near P6) AN
- (near P6) RST
- (near P6) CS
- (near P6) SCK
- (near P7) TX
- (near P7) RX
- (near P7) INT
- (near P7) PWM
- (near P12) Jumpers serial to FTDI, or use to breakout extra serial.
- (near SW7) Selects software app, or just user use. Need to enable pull-ups on FPGA.
- (near P6) MISO
- (near P6) MOSI
- (near P6) +3V3
- (near P6) GND
- (near P7) GND
- (near P7) +5V
- (near P7) SDA
- (near P7) SCL
- (near SW9) Force USBBOOT
- 3.3V Output (VCICO) for FPGA, front-end, etc.
- 1.8V for FPGA AUX + ADC_DIG
- (near SW8) Need to enable pull-ups on FPGA.
- nRST is longest PCB trace, taken out of group to avoid making length matching harder as length match is +/- 2 inches so will meet that anyway...
- W25Q64JVZEIQ or W25Q32JVZEIQ (32Mb should be fine, but seems to be less available). Consider 256 Mb if used for storage.
- Place near pin 44/45 (input/output caps for on-board regulator)
- (near R124) PCB: Place near Y3
- 200mA draw = 300mW power dissipation. Ensure some copper on the PCB for power dissipation!
- (near R211) 1.8V FPGA bank.
- (near P9) P9 is DNM, used for debug.
- (near C38) 1V Output (FPGA VCCINT)
  Goes to 1.06 in TURBO mode
- (near R19) Remove R19 if PWRIN>5V.
- VOut = 0.6 x (1+ Rtop/Rbot)
- (near SW6) Adjusts VCC-INT higher for TURBO mode.
- (near U19) DO
- (near U19) DI
- Need to enable pull-ups on FPGA.
- 50ppm 25MHz clock needed. If main FPGA clock is 25 MHz can maybe reuse. But chance we might need to use different frequency, so include pads for XTAL as well here.
  Note resistors on both side of trace (near OSC & XTAL), so that there isn't a big antenna being oscillated.
- (near R193) Inverted data line dealt with in FPGA.
- RP2040_TX is CFG data in, so needs to map to a SPI TX. CCLK should map to a same SPI SCK pin. The other pins are user-defined, but assumed to be for comms to FPGA post-configuration using SPI.
- FPGA bitstream storage - possibly can reduce size, confirm number of bitstreams needed.
- PREQ pin when asserted should cause FPGA to tri-state I/O pins, allowing the R-Pi to program the SPI flash.
- NOTE: The SPI pins can be remapped if needed for routing, just need to ensure keeps the same SPI peripheral. RP2040 doesn't have anything-goes pinmux, so need to hit right pins.
- 1.8V
- (near R77) 0603 size resistors so user can adjust if needed.
- (near U22) These are just clamps for analog input/digital pin. Can switch P/N if package isn't convient, and pinswap any of the I/O pins.
- 0-5V input. Impedance drops beyond 3.3V due to diode clamps on digital.
- 0-3V input
- (near R79) 2K||1K = 666R. Balanace P/N by adding 180R series. Based on Arty loosly.
- 0-1V output
- (near U15) XADC VCC Generation
- (near U14) NOTE on XADC_AGND:
  The area where XADC_AGND would live would have FPGA signals cross it. This will generate a lot of noise/issues... instead just made a single ground plane which should be better. In the future could seperate GND and ADCGND if required, but needs major routing changes.
- This SPI flash can be driven from both the FPGA and from the RP2040. Ideally placed between them with a sort of daisy-chain style routing FPGA-->SPI-->RP2040, as short as possible.
- (near U17) TODO - may be 128 Mbit on final.
- DWG. NO.
- REV.
- SHT.
- REVISION
- DESCRIPTION
- DATE
- APPROVED
- THIS DOCUMENT AND THE DATA DISCLOSED HEREIN OR HEREWITH IS THE PROPERTY OF ALTIUM LIMITED AND MAY BE FREELY DISTRIBUTED IN WHOLE. NO RIGHTS ARE RESERVED OR EXPRESS OR IMPLIED WARANTEE GIVEN.
- ENG:
- DSN:
- APPROVALS
- PROJECT
- DOCUMENT REVISION:
- DESIGN ITEM:
- CHK:
- BOM:
- REFERENCE DOCUMENTS
- PROJECT REVISION:
- TITLE
- FAB DWG:
- PCB DWG:
- ASSY DWG:
- SCALE:
- SIZE
- D
- CAGE CODE
- FILE NAME
- DWG NO.
- SHEET
- OF
- REV
- (in symbol Cap_16v_680uF) +
- (in symbol CMP-0383-00012-1, part A) BANK 14
- (in symbol CMP-0383-00012-1, part B) BANK 15
- (in symbol CMP-0383-00012-1, part C) BANK 16
- (in symbol CMP-0383-00012-1, part D) BANK 34
- (in symbol CMP-0383-00012-1, part E) BANK 35
- (in symbol CMP-2000-05150-1) CD/; DAT3; SD CARD
- (in symbol REF3012AIDBZT) 1.25 V REF